# EasyEDA Pro project M0G3507逐飞主板.eprj, board pcb (continued)
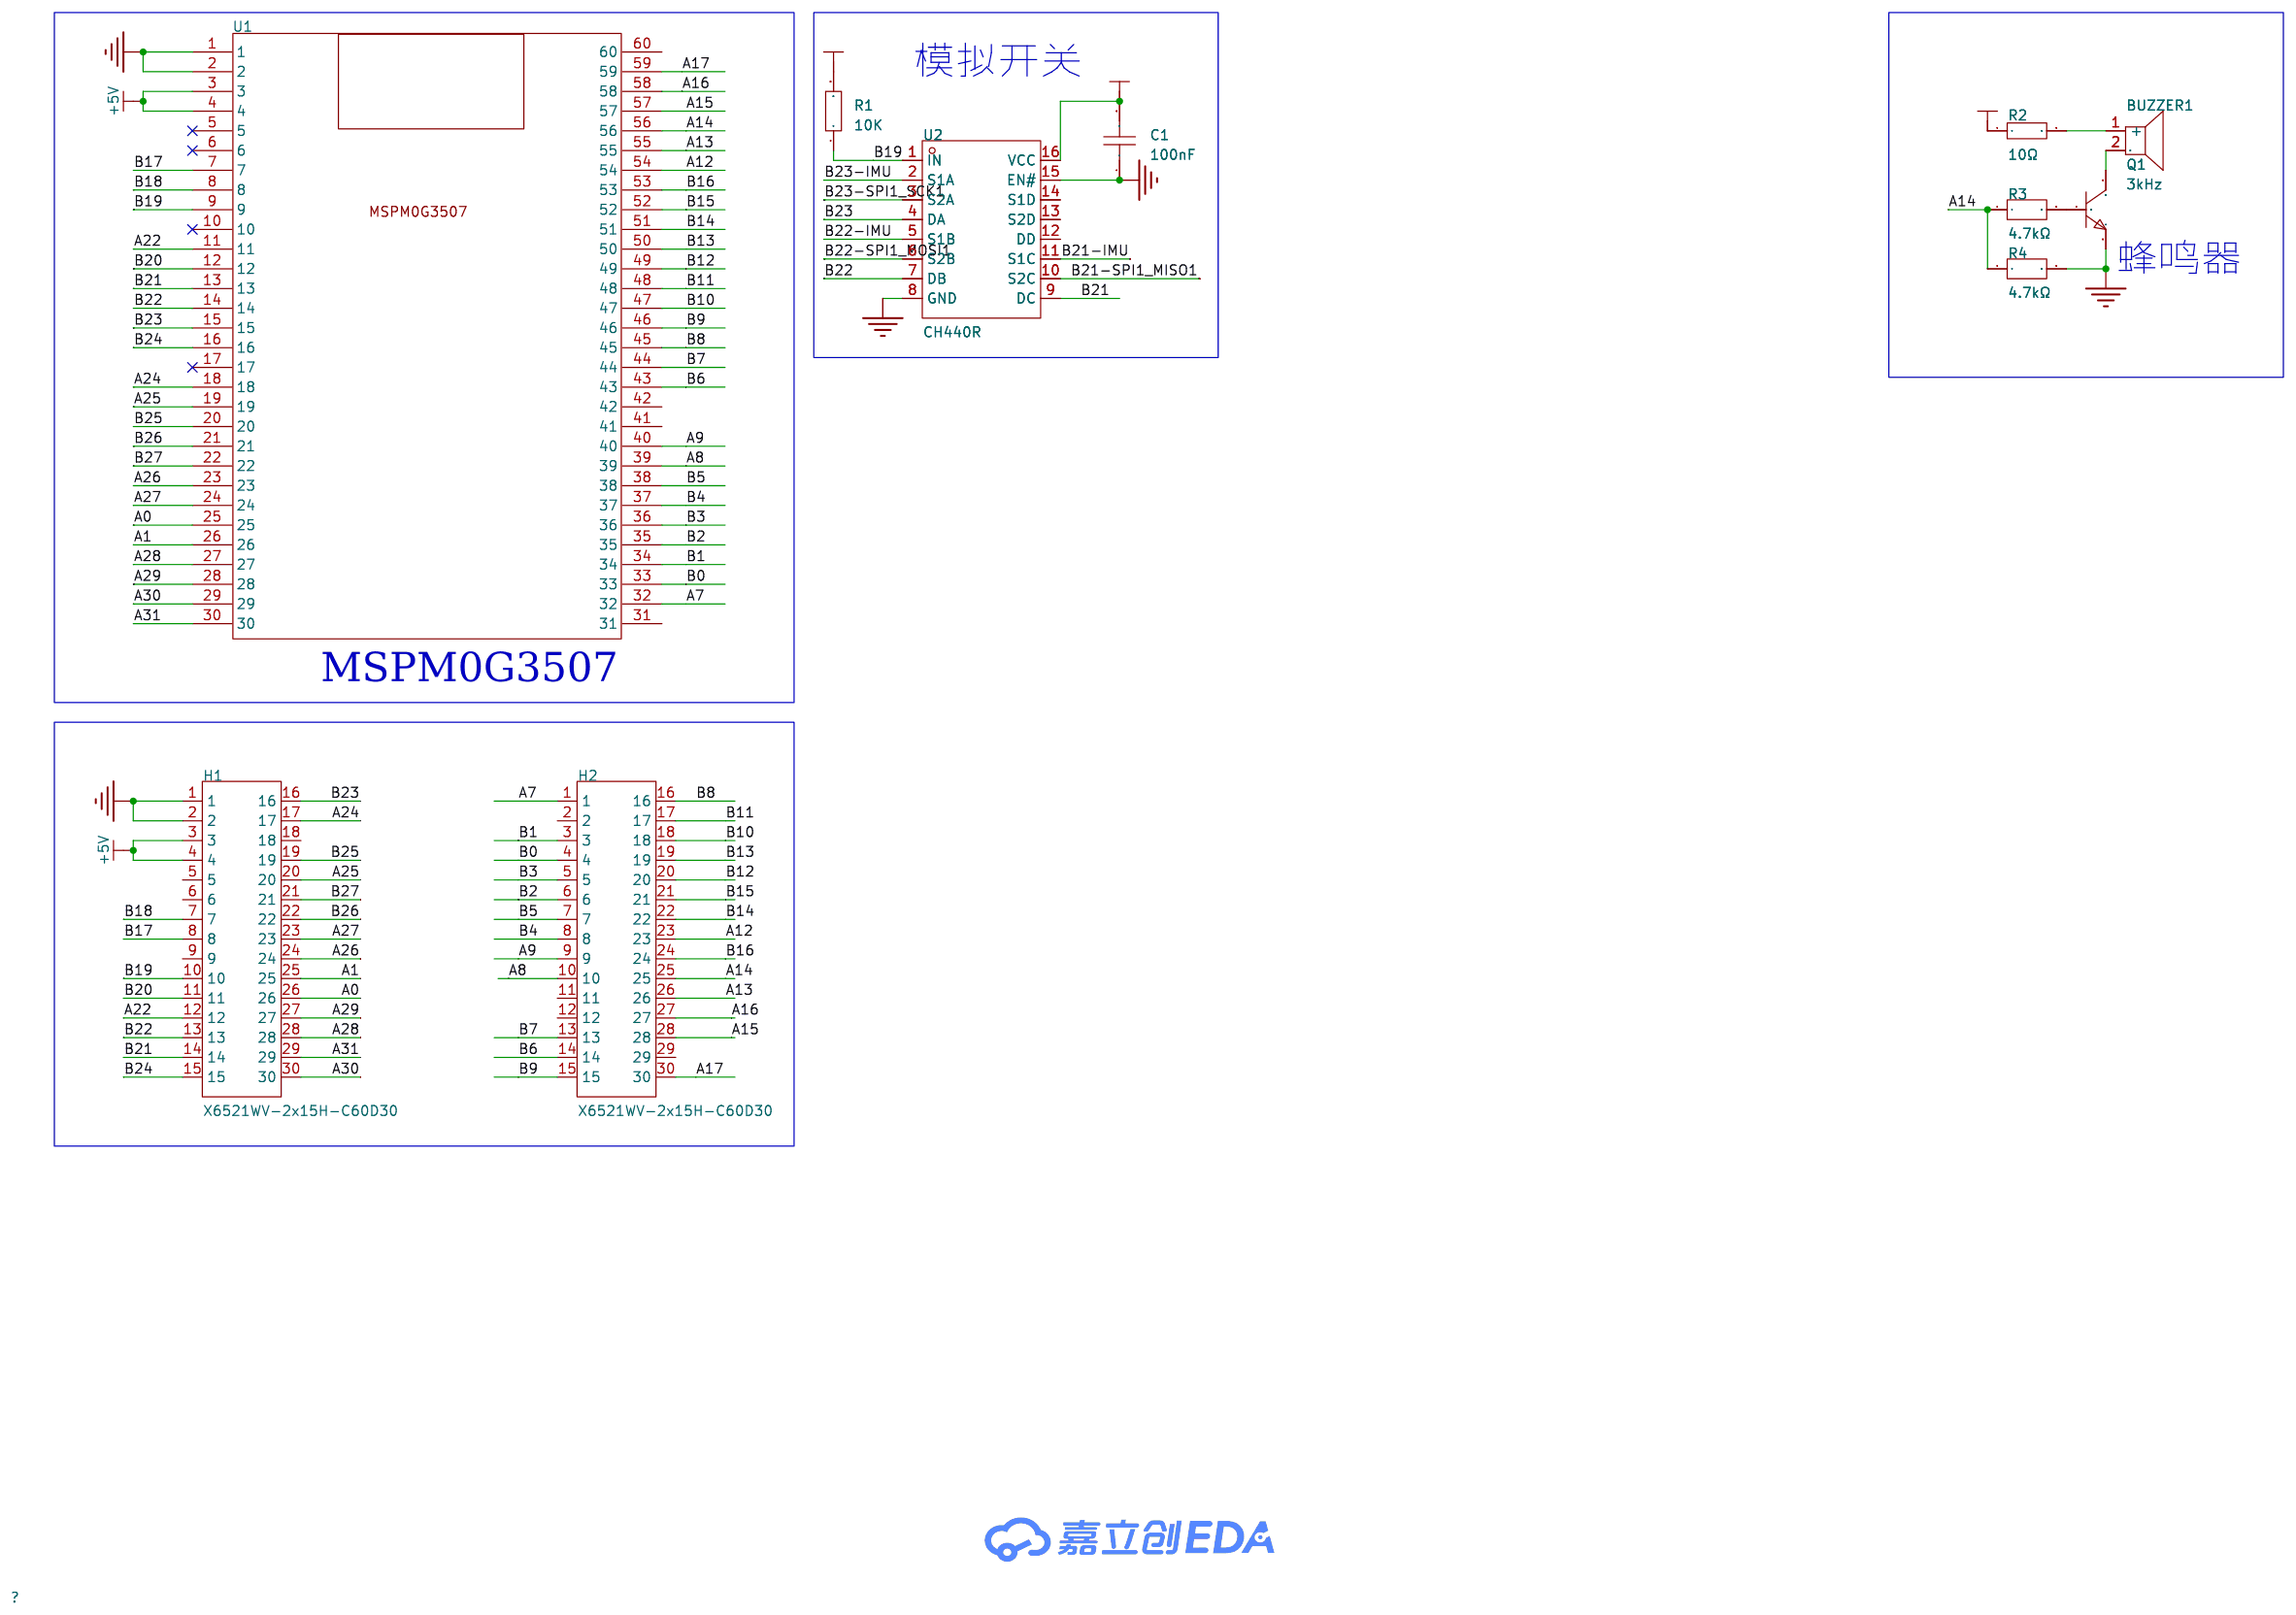
[diagram p0: 主控]
## Footprints (pads in the part's own frame, mm; a bottom-side part is the same pattern mirrored in y, then rotated) (continued)
  rect 1.6x1.5 smd: 2(-1.675,0.009)
SMA_L4.3-W2.6-LS5.0-FD
  rect 2.046x1.62 smd: 1(-2.304,-0.009) 2(2.304,0.009)
SOD-123_L2.7-W1.6-LS3.7-RD
  rect 0.91x1.22 smd: 1(-1.635,0) 2(1.635,0)
SOIC-16_L9.9-W3.9-P1.27-LS6.0-BL
  oval 0.602x1.971 smd: 1(-4.445,-2.736) 2(-3.175,-2.736) 3(-1.905,-2.736) 4(-0.635,-2.736) 5(0.635,-2.736) 6(1.905,-2.736) 7(3.175,-2.736) 8(4.445,-2.736) 9(4.445,2.736) 10(3.175,2.736) 11(1.905,2.736) 12(0.635,2.736) 13(-0.635,2.736) 14(-1.905,2.736) 15(-3.175,2.736) 16(-4.445,2.736)
SOT-23-3_L2.9-W1.3-P1.90-LS2.4-BR
  rect 1.25x0.7 smd: 1(1,-0.95) 2(1,0.95) 3(-1,0)
SOT-23-3_L3.0-W1.7-P0.95-LS2.9-BR
  rect 1.038x0.532 smd: 1(1.101,-0.95) 2(1.101,0.95) 3(-1.101,0)
SOT-23-5_L3.0-W1.7-P0.95-LS2.8-BL
  rect 0.49x1.157 smd: 1(-0.95,-1.153) 2(0,-1.153) 3(0.95,-1.153)
  rect 0.49x1.175 smd: 4(0.95,1.153) 5(-0.95,1.153)
SW-SMD_4P-L4.5-W4.5-P3.00-LS6.8
  rect 1.4x1.1 smd: 1(-3.25,1.5) 2(3.25,1.5) 3(-3.25,-1.5) 4(3.25,-1.5)
SW-TH_DSWB02LHGET
  round 1.8 hole 1.2: 1(-1.27,3.81) 2(1.27,3.81) 3(-1.27,-3.81) 4(1.27,-3.81)
SW-TH_SHOU-HAN_SS12D10G4
  oval 1.7x2.9 hole 1.1x2.3: 1(-4.8,0) 2(0,0) 3(4.8,0)
TO-252-2_L6.6-W6.1-P4.57-LS9.9-TL-CW
  rect 2.8x1.3 smd: 1(-3.292,2.273) 3(-3.292,-2.273)
  rect 6.5x6 smd: 2(3.292,0)
TSSOP-16_L5.0-W4.4-P0.65-LS6.4-BL
  oval 0.343x1.732 smd: 1(-2.275,-2.866) 2(-1.625,-2.866) 3(-0.975,-2.866) 4(-0.325,-2.866) 5(0.325,-2.866) 6(0.975,-2.866) 7(1.625,-2.866) 8(2.275,-2.866) 9(2.275,2.866) 10(1.625,2.866) 11(0.975,2.866) 12(0.325,2.866) 13(-0.325,2.866) 14(-0.975,2.866) 15(-1.625,2.866) 16(-2.275,2.866)
WIREPAD-4X6
  rrect 6x4 smd: 1(0,0)

## Nets
As in the schematic.

Pads without a net: CN2 3 4; H1 5 6 9 18; H2 2 11 12 29; H5 2; H6 2; H7 2; H9 5 6; H10 5 6; H13 6; NOREF 1; NOREF#2 1; NOREF#3 1; NOREF#4 1; NOREF#5 1; P2 7 8; U1 5 6 10 17 31 41 42 60; U2 12 13 14; U9 4; U10 7; U11 7 10; U12 5 6; X1 19 20

## Via types
v1: diameter 0.61, hole 0.305, Top Layer to Bottom Layer, 97 vias

## Routing (per net, layer and track width the routed paths; a pad name or vN(x,y) marks a point on that pad's centre or on a via; arc(x,y) is an arc through that point)
3V3: length 315.6
  Top Layer w0.254: 42.21,51.84 40.07,51.84
  Top Layer w0.508: U12.4 42.94,44.95 42.6,45.29 R55.2 ; H11.9 67,73.83 67,62.24 H15.2 70.01,59.47 71.42,60.87 71.42,61.94 72.02,62.55 76.92,62.55 77.09,62.71 ; R45.2 74.16,49.31 v1(74.16,50.05)
  Top Layer w0.762: 87.98,30.36 v1(87.98,32.59) 87.98,50.83 H10.2 86.27,54.2 82.22,58.25 R35.1 ; 87.98,30.36 87.92,30.31 R37.2 79.61,30.31 78.6,29.3 R31.2 ; 87.98,30.36 87.98,22.21 86.55,20.78 R39.2 ; 77.07,62.72 R20.2 ; 77.07,62.72 77.07,62.7 ; 77.07,62.72 77.07,62.73 C18.2 ; 40.43,50.2 40.3,50.08 R56.2 R55.2 ; 40.43,50.2 39.98,50.2 ; 40.43,50.2 R1.2 ; R45.2 75.13,49.23 79.84,44.52 79.84,41.31 ; 39.98,50.2 38.62,50.2 37.03,51.79 R2.1 37.03,69.3 36.11,70.22 P2.1 ; 39.98,50.2 40.02,50.24 C1.2 ; 79.84,41.31 74.76,41.31 74.08,40.64 R43.2 ; 79.84,41.31 85.03,41.31 ; R34.2 84.02,65.31 82.22,63.51 R35.1 ; 85.03,41.31 85,41.29 R41.2 ; 85.03,41.31 87.62,41.31 ; R35.1 H18.5 77.25,61.58 U9.5 77.09,62.71 ; H14.2 9.86,75.71 R46.2 ; U12.4 42.94,35.13 46.91,31.15 56.84,31.15 57.7,30.29 P1.2
  Inner1 w0.762: H14.2 10.23,74.52 10.36,74.38 ; 48.81,74.38 67.56,74.38 H11.9 ; 48.81,74.38 36.21,74.38 ; 48.81,74.38 48.81,74.39 H12.1 ; 36.21,74.38 36.11,74.28 P2.1 ; 36.21,74.38 10.36,74.38 ; H9.2 1.92,49.27 1.92,71.64 4.67,74.38 10.36,74.38
  Bottom Layer w0.254: 84.75,32.59 v1(87.98,32.59)
  Bottom Layer w0.508: Q4.1 70.62,51.84 71.09,52.31 R52.2 71.09,53.13 ; 71.09,53.13 72.17,53.13 72.44,53.4 73.03,53.4 73.21,53.22 74.69,53.22 74.69,53.23 R54.2 74.69,52.31 74.22,51.84 74.22,50.8 74.16,50.73 v1(74.16,50.05) ; 71.09,53.13 69.24,53.13 69.15,53.22 v1(67.53,53.22) R50.2 67.48,52.34 67.01,51.87 Q3.1
+5V: length 166.2
  Top Layer w0.508: U9.3 75.46,59.83 75.94,60.31 75.94,61.43 75.63,61.73 U9.1
  Top Layer w0.762: v1(81.78,49.85) 77.66,49.85 74.79,52.72 U9.3 ; 65.87,10.88 71.18,10.88 L1.1 ; 65.87,10.88 65.96,10.98 v1(65.96,12.66) D1.2 65.96,16.9 68.19,19.13 R6.2 ; 65.87,10.88 R5.2 46.64,9.53 45.97,8.85 33.42,8.85 32.68,8.12 H17.1 H16.1 ; U1.4 U1.3 64.42,35.51 H1.3 ; 72.63,59.78 73.65,59.78 ; 73.65,59.78 74.21,59.22 v1(74.21,58.81) ; 73.65,59.78 74.74,59.78
  Inner1 w0.762: v1(65.96,12.66) 76.65,12.66 81.78,17.79 81.78,35.52 ; H1.3 81.76,35.54 81.78,35.52 ; v1(81.78,49.85) 81.78,35.52
  Bottom Layer w0.762: H13.1 75.59,60.19 v1(74.21,58.81) ; R48.2 v1(81.78,49.85)
GND:
  vias: v1(3.55,60.11) v1(3.55,58.89) v1(3.55,57.72) v1(5.99,40.35) v1(9.14,11.8) v1(9.75,35.52) v1(21.38,40.75) v1(22.95,40.75) v1(26.51,10.02) v1(26.51,8.95) v1(27.68,11.24) v1(27.68,10.02) v1(27.68,8.95) v1(28.24,25.72) v1(28.24,24.6) v1(28.24,23.48) v1(28.24,22.47) v1(47.45,40.97) v1(47.45,39.9) v1(47.45,38.81) v1(47.45,37.45) v1(48.62,40.99) v1(48.62,39.93) v1(48.62,38.83) v1(48.62,37.47) v1(49.47,56.4) v1(55.16,22.85) v1(57.75,22.87) v1(66.55,43.49) v1(67.3,44.31) v1(67.96,34.61) v1(68.57,39.02) v1(68.84,34.59) v1(68.82,33.74) v1(69.74,64.58) v1(69.74,34.61) v1(72.58,71.89) v1(77.11,56.5) v1(78.12,37.71) v1(79.04,37.71) v1(83.15,66.51) v1(83.66,45.02) v1(83.66,43.9) v1(83.66,42.79) v1(84.01,59.3)
VCCSERVO: length 34.2
  Top Layer w0.508: R7.2 22.78,66.18 20.83,68.12 D2.2
  Inner2 w0.762: H4.2 52.82,74.23 37.18,74.23 H3.2
A0: length 53.2
  Top Layer w0.254: H1.26 61.88,63.45 U1.25
  Inner2 w0.254: H13.4 77.31,63.31 67.56,63.31 66.13,64.73 63.16,64.73 H1.26
  Bottom Layer w0.254: H12.2 48.45,74.23 56.74,74.23 59.58,71.39 59.58,65.33 U1.25
A1: length 66.9
  Top Layer w0.254: U1.26 56.47,62.14 63.11,62.14 H1.25
  Inner2 w0.254: U1.26 56.39,64.68 58.46,64.68 61.05,67.27 66.33,67.27 67.95,65.66 77.12,65.66 H13.3
  Bottom Layer w0.254: U1.26 56.49,64.78 58.31,64.78 59.02,65.49 59.02,70.12 55.57,73.57 46.57,73.57 H12.3
A7: length 72.8
  Top Layer w0.254: U1.32 33.48,67.17 25.7,67.17 25.37,67.49 H2.1
  Bottom Layer w0.254: U1.32 38.14,65.23 38.14,43.04 54.25,26.94 62.96,26.94 P1.5
A8: length 32
  Top Layer w0.254: U1.39 32.25,58.33 H2.10
  Inner1 w0.254: H9.4 5,51.27 16.5,51.27 22.29,57.06 26.65,57.06 H2.10
A9: length 61.2
  Top Layer w0.254: U1.40 33.58,57.11 26.59,57.11 H2.9 ; R24.1 v1(62.78,24.24)
  Bottom Layer w0.254: U1.40 37.28,55.93 37.28,42.63 54.25,25.67 61.36,25.67 v1(62.78,24.24)
A12: length 43.6
  Top Layer w0.254: U1.54 33.48,39.23 26.69,39.23 H2.23 ; R23.1 v1(60.24,24.24)
  Bottom Layer w0.254: U1.54 38.2,40.59 54.55,24.24 v1(60.24,24.24)
A13: length 46.1
  Top Layer w0.254: H2.26 32.25,38.01 U1.55
  Inner2 w0.254: U1.55 33.61,36.74 48.96,36.74 54.19,31.51 68.19,31.51 P1.7
A14: length 52.8
  Top Layer w0.254: U1.56 33.58,36.79 26.59,36.79 H2.25
  Top Layer w0.508: R4.1 v1(51.19,62.26) R3.1
  Inner1 w0.254: v1(51.19,62.26) 51.19,38.02 v1(51.2,38.01)
  Inner2 w0.254: v1(51.2,38.01) 51.16,38.05 U1.56
A15: length 42.5
  Top Layer w0.254: U1.57 32.25,35.47 H2.28
  Inner2 w0.254: P1.6 66.16,31 53.69,31 50.38,34.3 33.51,34.3 U1.57
A16: length 18.3
  Top Layer w0.254: U1.58 33.58,34.25 26.59,34.25 H2.27 22.93,35.47 22.89,35.5
  Top Layer w0.508: R13.2 R14.1 22.89,38.77 C8.1
A17: length 33.1
  Top Layer w0.254: H2.30 32.25,32.93 U1.59
  Bottom Layer w0.254: H2.30 26.64,34.2 22.07,34.2 H9.3
A22: length 39.4
  Top Layer w0.254: U1.11 57.73,45.7 H1.12 ; R44.2 v1(71.66,51.37)
  Inner1 w0.254: LED4.2 83.51,55.23 79.09,55.23 75.23,51.37 v1(71.66,51.37) 71.66,49.69 66.39,44.41 63.2,44.41 H1.12
A24: length 49.6
  Top Layer w0.254: H1.17 63.16,52.03 56.42,52.03 U1.18
  Inner1 w0.254: v1(69.03,52.23) 68.42,52.85 68.42,55.64 ; H1.17 66.77,55.64 68.42,55.64 ; 68.42,55.64 71.97,55.64 79.19,62.85 80.51,62.85 81.98,64.32 81.98,73.56 H11.3
  Bottom Layer w0.254: 68.5,52.23 v1(69.03,52.23)
  Bottom Layer w0.508: R50.1 68.39,52.31 68.91,51.79 Q3.2
A25: length 35.6
  Top Layer w0.254: H1.20 61.88,55.83 U1.19
  Inner1 w0.254: H1.20 63.11,57.06 67.61,57.06 68.72,58.18 71.72,58.18 79.43,65.88 79.43,73.55 H11.4
A26: length 46
  Top Layer w0.254: v1(66.68,57.89) 66.68,55.55 69.54,52.69 v1(72.74,52.69) ; H1.24 61.88,60.91 U1.23
  Inner1 w0.254: H1.24 63.16,62.19 66.74,62.19 67.76,63.21 70.35,63.21 74.22,67.08 74.22,73.43 H11.6
  Bottom Layer w0.254: v1(66.68,57.89) 66.68,57.99 65.01,59.65 63.2,59.65 H1.24 ; v1(72.74,52.69) 72.38,52.34 71.97,52.34
  Bottom Layer w0.508: Q4.2 72.52,51.79 71.97,52.34 R52.1
A27: length 53.2
  Top Layer w0.254: H1.23 63.16,59.65 56.42,59.65 U1.24
  Inner1 w0.254: H11.7 66.86,68.61 66.86,65.76 65.88,64.78 61.21,64.78 58.61,62.19 56.44,62.19 U1.24
  Bottom Layer w0.254: 75.56,52.34 75.63,52.41 v1(75.63,53.56) 70.96,58.23 67.17,58.23 H1.23
  Bottom Layer w0.508: 75.56,52.34 75.56,52.31 76.12,51.74 Q5.2
A28: length 57.7
  Top Layer w0.254: U12.3 41.82,40.54 v1(41.82,42.29) R55.1 ; H15.4 68.11,56.04 68.11,57.66 65.78,59.99 65.78,66.46 64.91,67.32 63.92,67.32 62.62,66.02 H1.28 61.88,65.99 U1.27
  Bottom Layer w0.254: U1.27 56.98,65.99 55.72,64.73 54.35,64.73 53.38,63.77 53.38,53.84 v1(41.82,42.29)
A29: length 81.7
  Top Layer w0.254: U1.28 56.42,64.73 63.16,64.73 H1.27 ; R38.2 82.2,20.57 81.73,21.04 v1(80.66,21.04)
  Inner1 w0.254: v1(80.66,21.04) 75.53,26.17 55.64,26.17 53.33,28.49 53.33,64.16 U1.28
A30: length 37.1
  Top Layer w0.254: U1.29 61.88,68.53 H1.30
  Bottom Layer w0.254: H1.30 63.2,67.27 65.53,67.27 67.1,65.71 67.1,62.09 68.47,60.72 70.55,60.72 76.04,55.23 80.63,55.23 81.98,53.88 81.98,51.75 H10.3
A31: length 60
  Top Layer w0.254: H15.3 66.28,60.41 66.28,66.73 H1.29 63.16,67.27 56.42,67.27 U1.30 ; R56.1 v1(40.3,42.32) 40.3,40.54 U12.2
  Bottom Layer w0.254: U1.30 52.21,65.59 52.21,54.23 v1(40.3,42.32)
AD3: length 45.8
  Top Layer w0.254: H1.19 63.16,54.57 56.42,54.57 U1.20
  Inner1 w0.254: U1.20 56.44,57.11 58.66,57.11 61.21,59.65 65.57,59.65 66.64,60.72 71.47,60.72 76.93,66.18 76.93,73.59 H11.5
AD6: length 47.6
  Top Layer w0.254: H1.15 64.42,50.75 63.41,50.75 62.1,49.44 57.19,49.44 56.68,49.95 55.96,49.95 U1.16
  Inner1 w0.254: H11.2 84.47,73.52 84.47,63.87 80.92,60.31 78.43,60.31 68.9,50.78 H1.15
AD7: length 51.8
  Top Layer w0.254: U1.12 56.42,44.41 63.16,44.41 H1.11
  Inner1 w0.254: H1.11 76.52,57.77 80.25,57.77 87.02,64.54 87.02,72.03 88.49,73.49 H11.1
B0: length 75.4
  Top Layer w0.254: U1.33 32.25,65.95 H2.4
  Inner1 w0.254: 40.3,4.28 39.01,5.58 39.01,7.99 38.24,8.75 31.89,8.75 29.56,11.09 29.56,63.25 U1.33
B1: length 81.6
  Top Layer w0.254: U1.34 33.53,64.68 26.64,64.68 H2.3
  Inner1 w0.254: H2.3 26.64,64.68 28.49,64.68 29.15,64.02 29.15,7.43 30.88,5.7 36.34,5.7 37.76,4.28
B2: length 103.1
  Top Layer w0.254: U1.35 32.25,63.41 H2.6
  Inner1 w0.254: H5.4 81.25,3.26 76.55,3.26 68.47,11.34 47.96,11.34 38.96,20.34 38.96,59.4 36.16,62.19 33.56,62.19 U1.35
B3: length 100.4
  Top Layer w0.254: U1.36 33.63,62.24 26.54,62.24 H2.5
  Inner1 w0.254: U1.36 36.07,63.45 39.62,59.91 39.62,20.91 48.62,11.9 70.26,11.9 H5.8
B4: length 21
  Top Layer w0.254: H2.8 32.25,60.87 U1.37 ; R25.2 v1(28.63,75.6)
  Bottom Layer w0.254: H2.8 29.51,62.46 29.51,74.72 v1(28.63,75.6)
B5: length 44.8
  Top Layer w0.254: H2.7 26.54,59.7 33.63,59.7 U1.38 ; R26.2 v1(62.07,76.42)
  Inner2 w0.254: U1.38 44.04,70.12 55.77,70.12 v1(62.07,76.42)
B6: length 104.5
  Top Layer w0.254: H2.14 32.25,53.25 U1.43
  Inner1 w0.254: U1.43 33.61,51.98 35.86,51.98 37.33,50.51 37.33,18.81 45.91,10.22 67.4,10.22 75.68,1.94 85.28,1.94 86.81,3.47 86.81,6.72 86.36,7.17 H5.1
B7: length 103
  Top Layer w0.254: H2.13 26.54,52.08 33.63,52.08 U1.44
  Inner1 w0.254: H5.3 83.86,5.92 83.86,3.92 82.54,2.6 75.99,2.6 67.76,10.83 46.89,10.83 38.19,19.53 38.19,50.68 35.58,53.29 U1.44
B8: length 79
  Top Layer w0.254: U1.45 32.25,50.71 H2.16
  Top Layer w0.508: R30.2 v1(62.39,1.28)
  Inner1 w0.254: v1(62.39,1.28) 45.36,1.28 42.76,3.87 42.76,6.87 30.01,19.63 30.01,48.47 U1.45
B9: length 88.4
  Top Layer w0.254: H2.15 26.59,49.49 33.58,49.49 U1.46
  Top Layer w0.508: R29.1 64.44,1.32 v1(64.41,1.28)
  Inner1 w0.254: v1(64.41,1.28) 63.64,2.04 45.71,2.04 43.53,4.23 43.53,7.12 30.42,20.23 30.42,48.27 31.61,49.46 33.55,49.46 U1.46
B10: length 98.2
  Top Layer w0.254: U1.47 27.96,48.21 H2.18
  Top Layer w0.508: R27.1 v1(56.58,7.07) ; R32.1 v1(13.91,5.93)
  Inner2 w0.254: v1(56.58,7.07) 51.21,1.7 31.59,1.7 24.7,8.59 16.57,8.59 v1(13.91,5.93)
  Bottom Layer w0.254: H2.18 30.31,45.77 30.31,15.75 v1(23.16,8.6)
B11: length 107.2
  Top Layer w0.254: H2.17 26.69,46.85 33.48,46.85 U1.48
  Top Layer w0.508: R28.1 v1(56.58,4.28) ; R33.1 v1(13.91,3.38)
  Inner2 w0.254: v1(56.58,4.28) 53.19,0.89 31.13,0.89 24.6,7.41 v1(22.2,7.41) 17.94,7.41 v1(13.91,3.38)
  Bottom Layer w0.254: H2.17 26.7,46.84 28.53,46.84 29.65,45.72 29.65,16.34 22.2,8.89 v1(22.2,7.41)
B12: length 67.4
  Top Layer w0.254: H2.20 27.96,45.67 U1.49
  Top Layer w0.508: v1(62.37,8.55) 62.39,8.56 R22.2
  Inner1 w0.254: U1.49 30.88,44.25 30.88,20.59 42.92,8.55 v1(62.37,8.55)
B13: length 72.5
  Top Layer w0.254: U1.50 33.53,44.36 26.64,44.36 H2.19
  Top Layer w0.508: R21.1 64.46,9.34 v1(64.46,8.55)
  Inner1 w0.254: U1.50 33.57,44.4 33.57,21.09 45.31,9.36 63.64,9.36 v1(64.46,8.55)
B14: length 41.8
  Top Layer w0.254: H2.22 32.25,43.09 U1.51
  Top Layer w0.762: R47.2 v1(15.28,73.11)
  Bottom Layer w0.254: v1(15.28,73.11) 15.28,53.56 24.48,44.36 26.64,44.36 H2.22
B15: length 49.8
  Top Layer w0.254: U1.52 33.53,41.82 26.64,41.82 H2.21
  Bottom Layer w0.254: U1.52 33.57,41.86 33.57,13.93 40.3,7.2
B16: length 41.2
  Top Layer w0.254: U1.53 32.25,40.55 H2.24
  Bottom Layer w0.254: 37.76,7.2 30.92,14.04 30.92,39.22 U1.53
B17: length 36.6
  Top Layer w0.254: H1.8 61.88,40.59 U1.7
  Inner1 w0.254: H10.4 84.95,48.68 83.3,48.68 82.54,49.44 82.54,50.84 80.69,52.69 77.72,52.69 66.9,41.87 63.16,41.87 H1.8
B18: length 37.4
  Top Layer w0.254: H1.7 63.21,39.38 56.37,39.38 U1.8 ; R36.2 82.33,28.98 v1(83.41,28.98)
  Inner2 w0.254: v1(83.41,28.98) 79.78,32.61 68.8,32.61 65.73,35.67 65.73,39.35 H1.7
B19: length 42.4
  Top Layer w0.254: R1.1 47.29,50.2 v1(47.84,50.76) ; v1(47.84,50.76) 47.94,50.86 U2.1 ; v1(47.84,50.76) 54.19,44.41 55.87,44.41 57.15,43.13 U1.9 57.73,43.16 H1.10
  Bottom Layer w0.254: P2.6 48.81,51.73 v1(47.84,50.76)
B21: length 25.2
  Top Layer w0.254: 42.21,56.39 44.68,56.39 45.35,57.06 49.68,57.06 52.62,54.11 52.62,51.52 54.7,49.44 56.47,49.44 U1.13 61.88,48.21 H1.14
B21-IMU: length 21
  Top Layer w0.254: v1(46.27,55.09) 42.21,55.09
  Bottom Layer w0.254: P2.5 v1(46.27,55.09)
B21-SPI1_MISO1: length 41.7
  Top Layer w0.254: 42.21,55.74 v1(45.15,55.74)
  Inner2 w0.254: v1(45.15,55.74) 45.15,55.08 48.3,51.93 51.4,51.93 53.87,54.4 67.67,54.4 69.03,53.05 71.7,53.05 73.05,54.4 75.66,54.4 76.1,53.96 H18.2
B22: length 22
  Top Layer w0.254: U2.7 49.87,55.74 52.01,53.59 52.01,51.36 U1.14 56.42,46.95 63.16,46.95 H1.13
B22-IMU: length 22.8
  Top Layer w0.254: v1(44.69,54.44) U2.5
  Bottom Layer w0.254: P2.4 41.89,70.23 41.89,57.24 v1(44.69,54.44)
B22-SPI1_MOSI1: length 39.1
  Top Layer w0.254: U2.6 49.21,55.09 v1(49.52,54.78)
  Inner2 w0.254: v1(49.52,54.78) 48.3,55.99 48.3,58.53 49.42,59.65 66.59,59.65 68.06,58.18 77.99,58.18 H18.3
B23: length 17.2
  Top Layer w0.254: U1.15 61.88,50.75 H1.16 ; v1(52.13,49.49) 51.14,50.48 51.14,52.09 49.44,53.79 U2.4
  Bottom Layer w0.254: v1(52.13,49.49) 56.44,49.49 U1.15
B23-IMU: length 24.8
  Top Layer w0.254: v1(43.88,52.49) U2.2
  Bottom Layer w0.254: P2.3 41.19,55.18 v1(43.88,52.49)
B23-SPI1_SCK1: length 43.1
  Top Layer w0.254: U2.3 49.18,53.14 v1(49.52,52.79)
  Inner2 w0.254: v1(49.52,52.79) 47.64,54.67 47.64,58.74 49.27,60.36 50.59,60.36 52.26,62.04 66.09,62.04 67.41,60.72 77.99,60.72 H18.4
B26: length 33.5
  Top Layer w0.254: U1.21 61.88,58.37 H1.22 62.7,58.4 63.95,59.65 65.08,59.65 65.88,58.85 65.88,42.89 67.05,41.72 70.15,41.72 71.64,40.23 R42.2
B27: length 51
  Top Layer w0.254: H1.21 63.11,57.06 56.47,57.06 U1.22 ; R40.2 82.46,39.62 81.98,40.09 v1(78.07,40.09)
  Inner2 w0.254: H1.21 67.22,55.64 77.82,55.64 78.22,55.23 80.6,55.23 82.36,53.47 82.36,44.39 v1(78.07,40.09)
CLK: length 22.7
  Inner2 w0.254: v1(79.19,48.83) 78.43,49.59 75.38,49.59 74.94,49.15 v1(72.33,49.15)
  Bottom Layer w0.254: Q4.3 71.57,49.03 71.69,49.15 v1(72.33,49.15) ; U11.2 69.21,39.2 69.84,39.84 69.84,43.5 69.21,44.13 U10.2
  Bottom Layer w0.508: Q4.3 69.91,48.8 69.21,48.09 U10.2 ; R51.1 v1(79.19,48.83)
DATA: length 18
  Inner1 w0.254: v1(80.36,48.83) 80.36,43.57 v1(76.8,40.02)
  Bottom Layer w0.254: v1(76.8,40.02) 76.83,40.04 U10.9
  Bottom Layer w0.508: Q5.3 76.13,48.8 76.88,49.54 79.65,49.54 v1(80.36,48.83) R53.1
IN1: length 13.5
  Bottom Layer w0.254: U10.6 74.29,45.66 74.57,45.38 78.88,45.38 83.17,41.09 84.75,41.09
IN2: length 15.2
  Bottom Layer w0.254: 84.75,40.59 82.96,40.59 78.58,44.97 73.3,44.97 73.02,45.25 U10.5
IN3: length 16.8
  Bottom Layer w0.254: U10.4 71.75,45.05 72.23,44.56 78.27,44.56 82.75,40.09 84.75,40.09
IN4: length 18.1
  Bottom Layer w0.254: U10.3 70.48,45.29 71.61,44.16 78.02,44.16 82.59,39.59 84.75,39.59
IN5: length 18
  Bottom Layer w0.254: 84.75,39.09 82.32,39.09 77.72,43.7 71.47,43.7 70.48,42.71 U10.14
IN6: length 16.4
  Bottom Layer w0.254: U10.13 71.75,42.46 72.53,43.24 77.31,43.24 81.96,38.59 84.75,38.59
IN7: length 15
  Bottom Layer w0.254: 84.75,38.09 81.7,38.09 77,42.79 73.35,42.79 73.02,42.46 U10.12
IN8: length 12.9
  Bottom Layer w0.254: U10.11 74.29,39.87 74.72,39.43 79.19,39.43 81.03,37.59 84.75,37.59
IN9: length 12.6
  Bottom Layer w0.254: U11.6 74.29,38.8 74.57,39.08 78.63,39.08 80.61,37.09 84.75,37.09
IN10: length 13
  Bottom Layer w0.254: U11.5 72.99,37.62 72.99,36.64 73.25,36.38 82.08,36.38 82.29,36.59 84.75,36.59
IN11: length 14.4
  Bottom Layer w0.254: 84.75,36.09 82.41,36.09 82.31,35.99 72.22,35.99 71.75,36.46 U11.4
IN12: length 15.9
  Bottom Layer w0.254: U11.3 70.48,36.33 71.21,35.59 84.75,35.59
IN13: length 16.5
  Bottom Layer w0.254: 84.75,35.09 71.63,35.09 70.48,33.94 U11.14
IN14: length 14.9
  Bottom Layer w0.254: 84.75,34.59 72.76,34.59 71.79,33.62 71.75,33.62 U11.13
IN15: length 13.4
  Bottom Layer w0.254: 84.75,34.09 73.44,34.09 73.02,33.67 U11.12
IN16: length 11.7
  Bottom Layer w0.254: 84.75,33.59 74.57,33.59 74.29,33.31 U11.11
IPS_BL: length 2.7
  Top Layer w0.508: R31.1 P1.8
SH: length 23
  Inner2 w0.254: v1(78.02,48.83) 77.57,48.38 69.53,48.38 v1(68.77,49.14)
  Bottom Layer w0.254: U10.1 67.94,44.03 68.57,43.4 68.57,39.99 67.94,39.36 U11.1 ; v1(68.77,49.14) 68.3,49.14 Q3.3
  Bottom Layer w0.508: R49.1 v1(78.02,48.83) ; Q3.3 67.96,46.82 U10.1
VD: length 31.4
  Inner2 w0.254: v1(78.63,47.31) 74.7,47.31 v1(66.49,39.09)
  Bottom Layer w0.254: U11.16 67.94,32.56 C20.1 v1(66.49,39.09) C21.1 67.93,41.33 U10.16
  Bottom Layer w0.508: R48.1 81.67,47.31 80.61,47.31 80.59,47.33 R53.2 R51.2 R49.2
$1N2734: length 5.3
  Top Layer w0.762: R2.2 43.84,60.73 BUZZER1.1
$1N2847: length 8.2
  Top Layer w0.508: Q1.3 45.78,67.67 BUZZER1.2
$1N2885: length 1.7
  Top Layer w0.508: R3.2 50.29,63.83 Q1.1
$2N1003: length 2.2
  Top Layer w0.508: R15.1 33.53,13.08 U5.4
$2N1004: length 2
  Top Layer w0.508: R9.2 41.15,14.36 U5.6
$2N1009: length 1.7
  Top Layer w0.508: R10.2 R5.1
$2N1010: length 4.2
  Top Layer w0.508: R10.1 41.96,11.43 41.33,12.07 R16.2 41.25,12.46 40.63,12.46 40,13.09 U5.5
$2N1012: length 1.6
  Top Layer w0.762: LED1.2 70.85,19.13 R6.1
$2N1013: length 1.8
  Top Layer w0.508: R9.1 43.04,15.7 C9.1
$2N1020: length 1.6
  Top Layer w0.762: LED3.2 R20.1
$2N1750: length 1.8
  Top Layer w0.508: R17.1 20.87,47.98 U6.4
$2N1751: length 2
  Top Layer w0.762: R11.2 17.7,53.92 U6.6
$2N1759: length 1.9
  Top Layer w0.762: R8.1 13.25,70.45 LED2.2
$2N1760: length 1.8
  Top Layer w0.762: C10.1 19.21,57.44 R11.1
$2N1803: length 2
  Top Layer w0.762: R7.1 22.76,59.64 R12.1
$2N1805: length 1.8
  Top Layer w0.762: R18.2 20.61,57.8 R12.3
$2N1809: length 3
  Top Layer w0.762: U6.5 20.1,53.8 20.72,54.42 21.62,54.42 R12.2
$2N2502: length 19
  Top Layer w0.762: v1(9.75,31.92) 9.7,31.96 Q2.1
  Bottom Layer w0.762: v1(9.75,31.92) 9.75,21.98 SW1.2
$2N2504: length 13.1
  Top Layer w0.762: SW1.3 7.51,14.95 7.51,20.28 8.14,20.91 R19.2 9.31,22.2
$3N1560: length 2.3
  Top Layer w0.762: R25.1 32.46,76.42 H3.3
$3N1658: length 2.3
  Top Layer w0.762: H4.3 57.54,76.42 R26.1
$3N2807: length 2.4
  Top Layer w0.254: R22.1 60.9,9.34 H8.2
$3N2808: length 2.4
  Top Layer w0.254: R21.2 65.98,9.33 H8.6
$3N2809: length 2.4
  Top Layer w0.254: R29.2 65.98,2.15 H8.5
$3N2810: length 2.3
  Top Layer w0.254: R30.1 60.9,2.14 H8.1
$3N3490: length 2.4
  Top Layer w0.762: H13.5 85.75,66.82
$3N3768: length 2.7
  Top Layer w0.508: R23.2 P1.3
$3N3769: length 2.7
  Top Layer w0.508: R24.2 P1.4
$3N4941: length 12.2
  Top Layer w0.508: R41.1 85,36.63 SW5.2 ; C24.2 86.75,36.57 SW5.2 ; 80.97,36.57 SW5.1 ; 80.97,36.57 80.95,36.6 R40.1 ; 80.97,36.57 SW5.2
$3N4945: length 12.1
  Top Layer w0.508: 74.14,36.6 74.14,38.27 R43.1 ; 74.14,36.6 70.22,36.6 ; 74.14,36.6 C25.2 ; 74.14,36.6 SW6.2 ; 70.22,36.6 67.67,36.6 SW6.1 ; 70.22,36.6 70.13,36.69 R42.1
$3N4950: length 12.3
  Top Layer w0.508: 80.74,17.52 80.74,19.6 R38.1 ; 80.74,17.52 SW4.2 ; 80.74,17.52 SW4.1 ; SW4.2 84.62,17.6 R39.1 ; SW4.2 86.5,17.52 C23.2
$3N4953: length 12.1
  Top Layer w0.508: R36.1 80.77,27.08 80.76,27.07 ; 86.59,27.07 84.78,27.07 ; 84.78,27.07 SW3.2 ; 84.78,27.07 84.78,28.77 R37.1 ; 84.78,27.07 80.76,27.07 ; 80.76,27.07 78.3,27.07 SW3.1
$3N6894: length 2.3
  Top Layer w0.254: R27.2 54.22,7.13 H6.3
$3N6896: length 2.4
  Top Layer w0.254: R28.2 51.98,4.28 51.93,4.23
$3N7040: length 4.6
  Top Layer w0.254: R46.1 12.9,73.11 12.77,73.25 H14.3
$3N7301: length 2.2
  Top Layer w0.508: R32.2 SW2.1
$3N7302: length 2.1
  Top Layer w0.508: R33.2 11.67,3.39 SW2.2
$3N18380: length 12.8
  Top Layer w0.254: v1(76.8,30.75) 77.16,31.1 77.16,38.47 v1(75.56,40.07)
  Bottom Layer w0.254: U11.9 76.8,32.15 v1(76.8,30.75) ; U10.10 v1(75.56,40.07)
$3N22983: length 11.8
  Top Layer w0.508: 70.18,46.25 67.67,46.25 SW7.1 ; 70.18,46.25 70.15,46.28 R44.1 ; 70.18,46.25 C26.2 ; SW7.2 74.08,46.35 R45.1
$3N25046: length 3.2
  Top Layer w0.762: LED4.1 86,61.58 R35.2

## Copper pours and planes (outline as drawn; the poured copper is in the pictures)
GND on Top Layer: -5.6,84.14 103.06,84.14 103.06,-11.37 -5.6,-11.37
GND on Bottom Layer: -3.26,80.63 95.55,80.63 95.55,-2.78 -3.26,-2.78
GND on Inner1: -4.28,85.56 102.2,85.56 102.2,-12.23 -4.28,-12.23
GND on Inner2: -2.24,81.8 95.24,81.8 95.24,-7.3 -2.24,-7.3
VCC on Top Layer: 0.55,19.72 0.55,29.17 1.31,29.93 10.96,29.93 11.29,29.61 11.29,25.94 10.2,24.85 7.53,24.85 6.65,23.97 6.65,19.77 5.75,18.87 1.4,18.87
VCCBAT on Top Layer: 22.04,10.26 20.75,8.97 20.75,2.62 19.69,1.55 15.72,1.55 14.77,2.5 14.77,6.31 12.23,8.85 12.23,35.36 14.17,37.3 19.23,37.3 22.01,34.52 22.01,30.5 23.13,29.38 29.48,29.38 29.89,28.97 29.89,27.93 29.56,27.61 22.74,27.61 22.01,26.89 22.01,10.29
VCCSERVO on Top Layer: 21.23,68.77 22.36,68.77 22.36,66.67 21.23,66.67
VCCSERVO on Top Layer: 15.99,71.23 17.21,70.02 20.26,70.02 25.09,74.84 32.91,74.84 33.67,75.6 33.67,77.03 34.08,77.43 35.7,77.43 36.11,77.03 36.11,74.54 33.16,71.59 26.16,71.59 21.83,67.26 15.19,67.26 14.76,67.7 14.76,69.47 14.01,70.22 14.01,70.98 14.27,71.23
$2N1000 on Top Layer: 34.49,16.47 36.23,18.21 36.23,19.53 35.86,19.9 33.44,19.9 32.68,19.14 32.68,16.73 32.94,16.47
$2N1001 on Top Layer: 38.73,16.34 36.57,18.51 36.57,19.62 36.85,19.9 38.9,19.9 39.54,19.27 46.27,19.27 47.54,18 47.54,14.44 47.16,14.06 44.87,14.06 44.49,14.44 44.49,15.96 44.11,16.34
$2N1002 on Top Layer: 26.71,26 27.09,25.62 27.09,19.9 30.01,16.98 32.13,16.98 32.89,16.22 34.08,16.22 34.31,15.99 34.31,14.04 34.08,13.81 32.59,13.81 31.96,13.17 29.51,13.17 26.57,16.11 24.23,16.11 23.28,17.06 23.28,25.6 23.69,26
$2N1006 on Top Layer: 50.53,21.37 66.82,21.37 67.04,21.15 67.04,19.06 66.49,18.5 64.46,18.5 63.31,17.36 58.33,17.36 55.29,14.31 50.18,14.31 49.52,14.97 49.52,20.36
$2N1747 on Top Layer: 13.78,50.74 15.66,48.86 15.66,47.33 15.41,47.08 12.37,47.08 12.12,47.33 12.12,50.45 12.41,50.74
$2N1748 on Top Layer: 13.71,51.08 15.92,53.29 15.92,56.73 15.03,57.62 10.76,57.62 10.12,56.98 10.12,52.31 11.34,51.08
$2N1749 on Top Layer: 18.97,38.95 19.35,39.33 19.35,45.56 18.33,46.57 18.33,48.86 18.2,48.98 16.3,48.98 16.04,48.73 16.04,47.48 17.19,46.34 17.19,44.79 16.81,44.41 13.07,44.41 12.31,43.65 12.31,39.64 13,38.95
$2N1753 on Top Layer: 14.39,60.29 14.77,60.67 14.77,62.79 14.27,63.3 14.27,68.56 13.32,69.5 7.86,69.5 6.39,68.03 6.39,62.96 9.06,60.29
$3N2354 on Top Layer: 73.83,6.15 73.47,5.79 73.47,4.24 73.09,3.86 70.19,3.86 69.78,4.27 69.78,8.46 70.16,8.84 78.17,8.84 78.55,8.46 78.55,6.5 78.2,6.15

Small or netless copper shapes (teardrops, artwork), in the pictures only: 366 on Top Layer, 132 on Bottom Layer, 60 on Inner1, 38 on Inner2

## Text on the board
Bottom Silkscreen Layer: en | g  3.3 | data-a27 | sck-a26 | SH-A24 | 1-16 | Bit Dawnbreaker | 16路红外引脚
Top Silkscreen Layer: 3v3 | g | a27 | a26 | b25 | a25 | a24 | b24 | B20 | GND | B23 | sck | B22 | mo | B21 | mi | B19 | a12 | a9 | cs | no | gnd | 3.3 | A7 | rst | a15 | dc | a13 | sda | a31 | a28 | A16_led | B27 | a22 | B26 | b18 | A29 | G | b17 | p | a30 | b16 | b15 | RX | TX | a1 | a0 | a8 | a17 | P | cmd | b3 | 5v | rts | b2 | rx | b7 | b6 | b4 | b5 | 5V | B10 | TOF | b1 | b0 | B12 | B8 | B11 | B13 | B9 | IIC0 | spi1 | vcc | M0g3507 | Bofeng | 舵机供电 | 灰度循迹 | 超声波 | 5V电源 | 舵机 | 电磁感应 | 庐山派供电 | 3V3电源 | 无线串口 | 编码器 | IIC0_庐山派 | 屏幕 | 姿态传感器 | 串口2 | 无刷 | 有刷 | 串口0 | 驱动供电 | 关 | 开
